# EasyEDA Pro project wukong01-Y003-HTOL - 2.eprj, board PCB1 (continued)
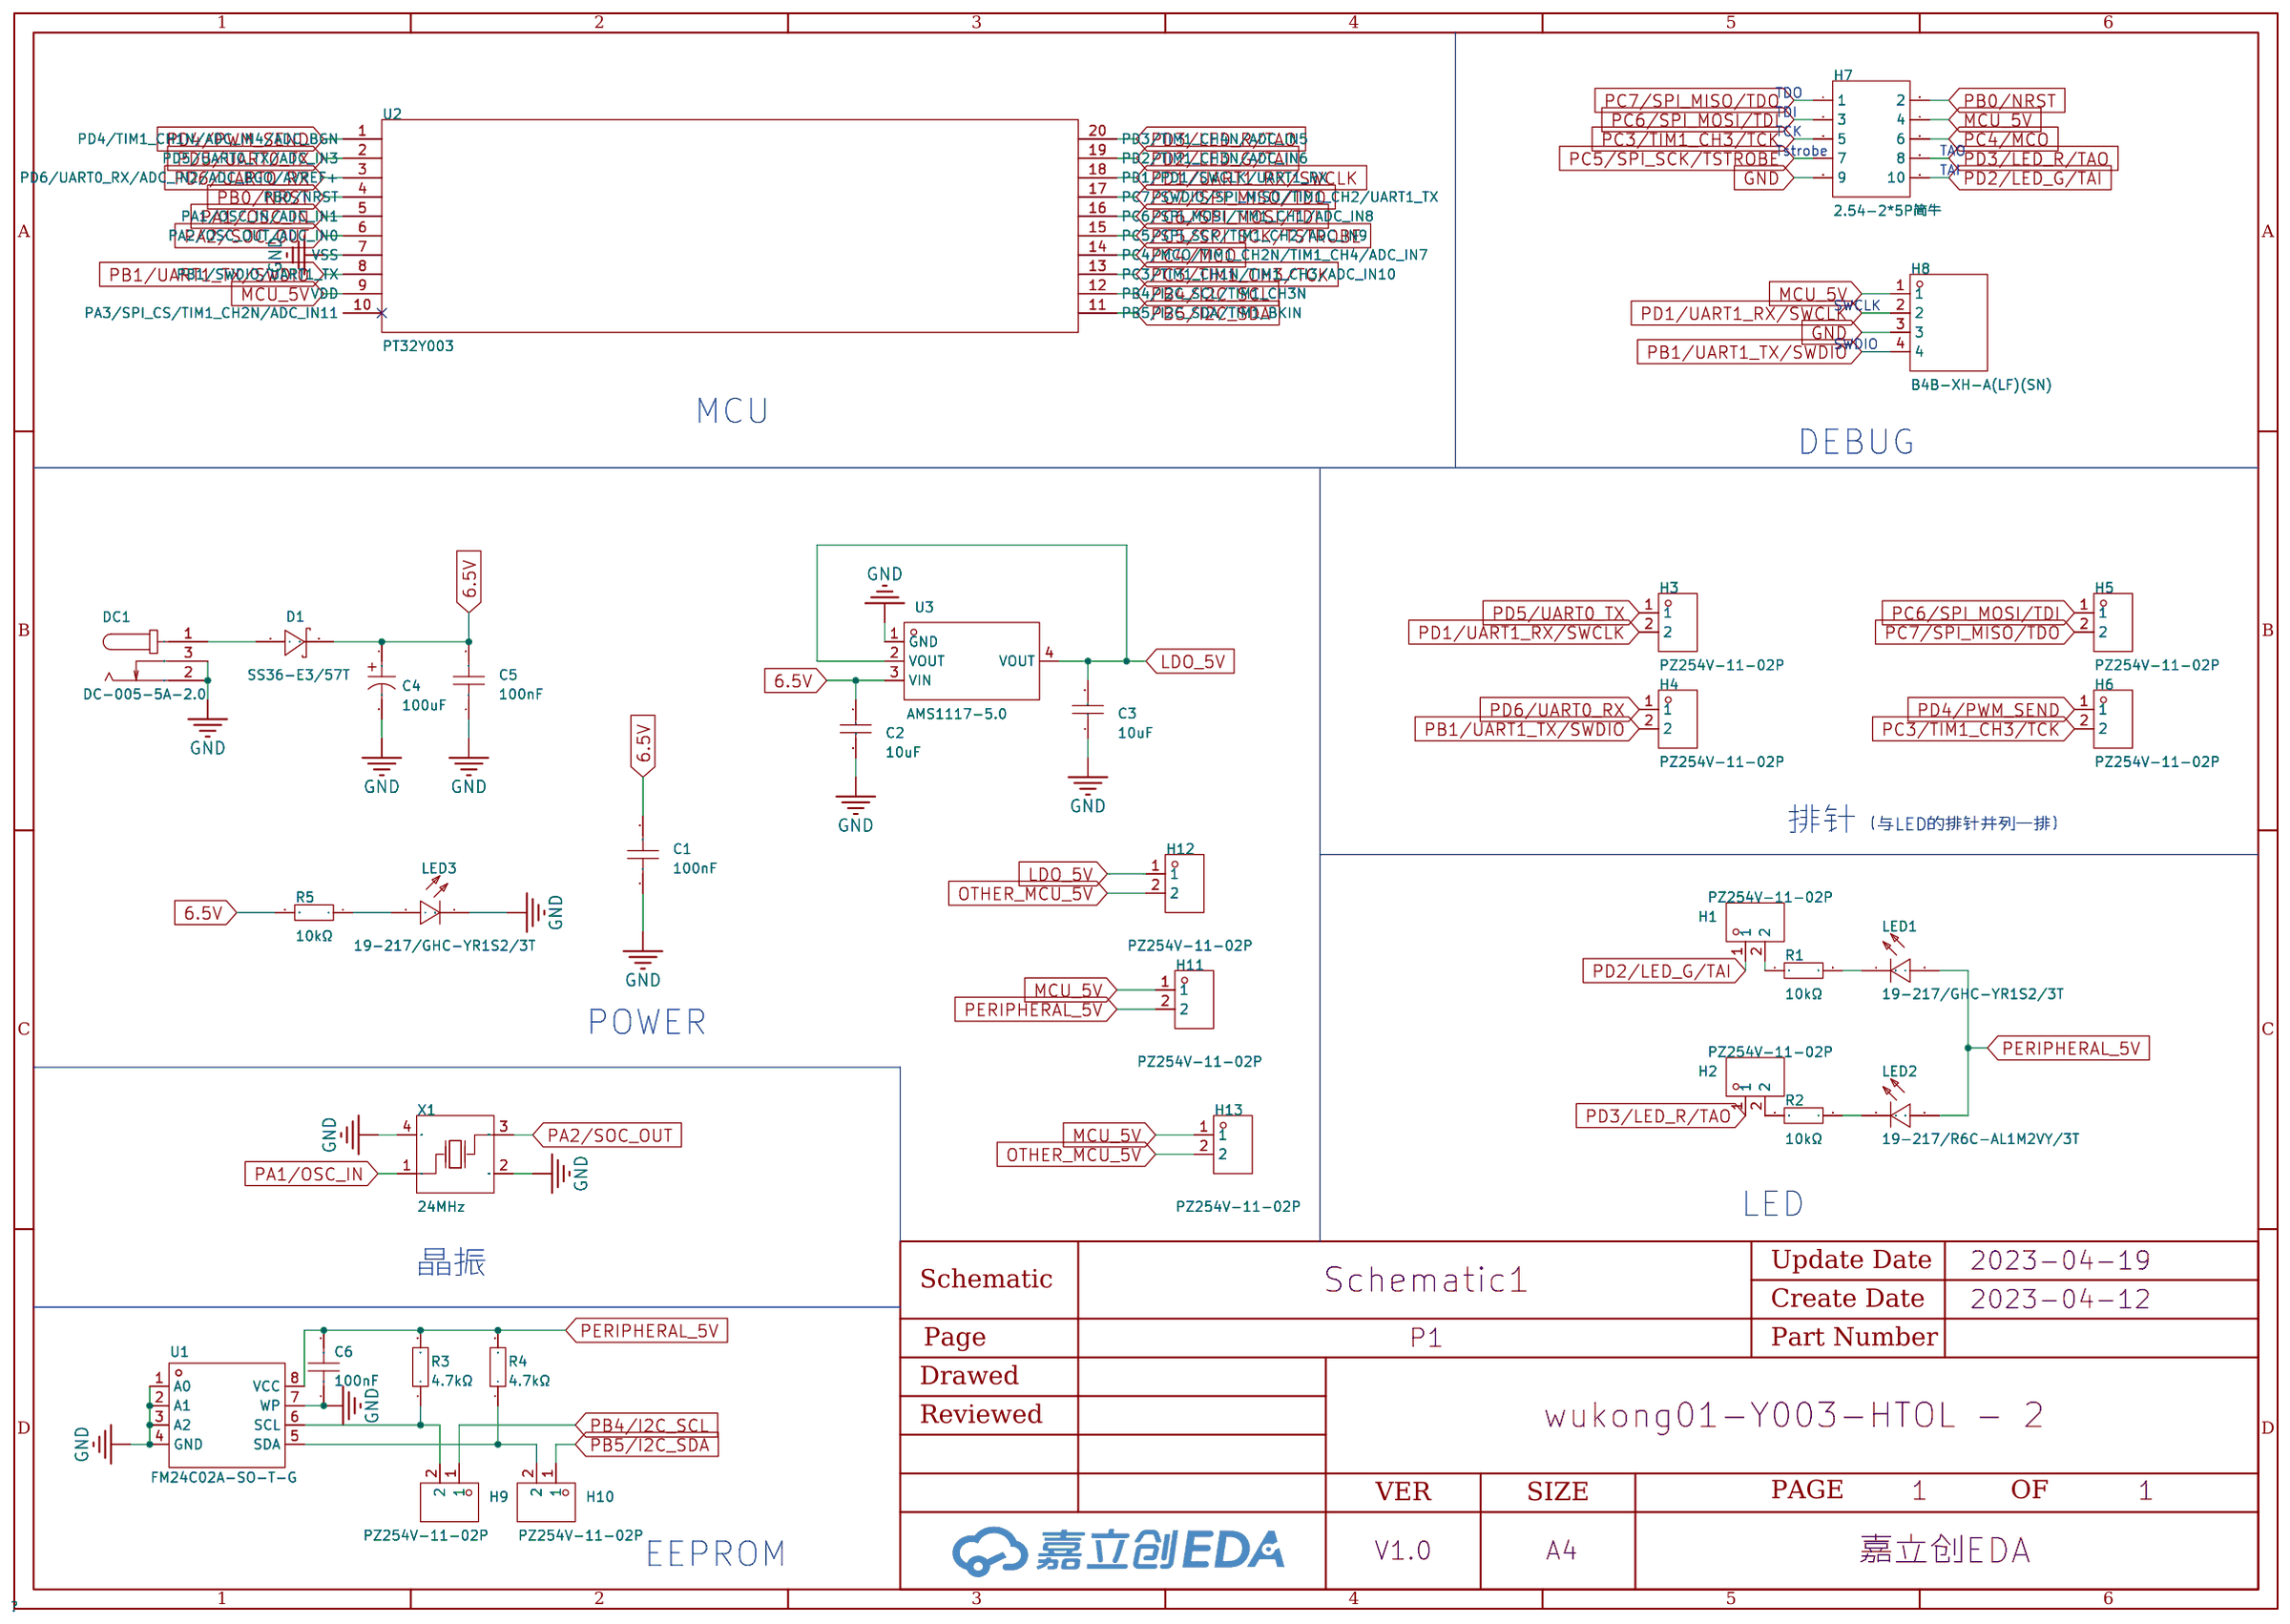
[diagram p0: schematic sheet]
## Placement (name value [footprint] x y rotation side) (continued)
H10#24  -  [HDR-TH_2P-P2.54-V-M]  94.78 55.52 0 top
H10#25  -  [HDR-TH_2P-P2.54-V-M]  139.78 55.52 0 top
H10#26  -  [HDR-TH_2P-P2.54-V-M]  184.78 55.52 0 top
H10#27  -  [HDR-TH_2P-P2.54-V-M]  274.78 55.52 0 top
H10#28  -  [HDR-TH_2P-P2.54-V-M]  49.78 55.52 0 top
H10#29  -  [HDR-TH_2P-P2.54-V-M]  229.78 17.52 0 top
H10#30  -  [HDR-TH_2P-P2.54-V-M]  94.78 17.52 0 top
H10#31  -  [HDR-TH_2P-P2.54-V-M]  139.78 17.52 0 top
H10#32  -  [HDR-TH_2P-P2.54-V-M]  184.78 17.52 0 top
H11  PZ254V-11-02P  [HDR-TH_2P-P2.54-V-M]  94.78 204.98 0 top
H11#2  -  [HDR-TH_2P-P2.54-V-M]  139.78 204.98 0 top
H11#3  -  [HDR-TH_2P-P2.54-V-M]  184.78 204.98 0 top
H11#4  -  [HDR-TH_2P-P2.54-V-M]  229.78 204.98 0 top
H11#5  -  [HDR-TH_2P-P2.54-V-M]  229.78 166.98 0 top
H11#6  -  [HDR-TH_2P-P2.54-V-M]  139.78 166.98 0 top
H11#7  -  [HDR-TH_2P-P2.54-V-M]  94.78 166.98 0 top
H11#8  -  [HDR-TH_2P-P2.54-V-M]  184.78 166.98 0 top
H11#9  -  [HDR-TH_2P-P2.54-V-M]  274.78 166.98 0 top
H11#10  -  [HDR-TH_2P-P2.54-V-M]  49.78 166.98 0 top
H11#11  -  [HDR-TH_2P-P2.54-V-M]  229.78 128.98 0 top
H11#12  -  [HDR-TH_2P-P2.54-V-M]  139.78 128.98 0 top
H11#13  -  [HDR-TH_2P-P2.54-V-M]  94.78 128.98 0 top
H11#14  -  [HDR-TH_2P-P2.54-V-M]  184.78 128.98 0 top
H11#15  -  [HDR-TH_2P-P2.54-V-M]  274.78 128.98 0 top
H11#16  -  [HDR-TH_2P-P2.54-V-M]  49.78 128.98 0 top
H11#17  -  [HDR-TH_2P-P2.54-V-M]  229.78 90.98 0 top
H11#18  -  [HDR-TH_2P-P2.54-V-M]  139.78 90.98 0 top
H11#19  -  [HDR-TH_2P-P2.54-V-M]  94.78 90.98 0 top
H11#20  -  [HDR-TH_2P-P2.54-V-M]  184.78 90.98 0 top
H11#21  -  [HDR-TH_2P-P2.54-V-M]  274.78 90.98 0 top
H11#22  -  [HDR-TH_2P-P2.54-V-M]  49.78 90.98 0 top
H11#23  -  [HDR-TH_2P-P2.54-V-M]  229.78 52.98 0 top
H11#24  -  [HDR-TH_2P-P2.54-V-M]  139.78 52.98 0 top
H11#25  -  [HDR-TH_2P-P2.54-V-M]  94.78 52.98 0 top
H11#26  -  [HDR-TH_2P-P2.54-V-M]  184.78 52.98 0 top
H11#27  -  [HDR-TH_2P-P2.54-V-M]  274.78 52.98 0 top
H11#28  -  [HDR-TH_2P-P2.54-V-M]  49.78 52.98 0 top
H11#29  -  [HDR-TH_2P-P2.54-V-M]  229.78 14.98 0 top
H11#30  -  [HDR-TH_2P-P2.54-V-M]  139.78 14.98 0 top
H11#31  -  [HDR-TH_2P-P2.54-V-M]  94.78 14.98 0 top
H11#32  -  [HDR-TH_2P-P2.54-V-M]  184.78 14.98 0 top
H12  PZ254V-11-02P  [HDR-TH_2P-P2.54-V-M]  5.46 201.29 270 top
H12#2  -  [HDR-TH_2P-P2.54-V-M]  22.71 201.55 270 top
H12#3  -  [HDR-TH_2P-P2.54-V-M]  40.77 201.68 270 top
H12#4  -  [HDR-TH_2P-P2.54-V-M]  55.88 223.27 0 top
H13  PZ254V-11-02P  [HDR-TH_2P-P2.54-V-M]  94.78 202.44 0 top
H13#2  -  [HDR-TH_2P-P2.54-V-M]  139.78 202.44 0 top
H13#3  -  [HDR-TH_2P-P2.54-V-M]  184.78 202.44 0 top
H13#4  -  [HDR-TH_2P-P2.54-V-M]  229.78 202.44 0 top
H13#5  -  [HDR-TH_2P-P2.54-V-M]  139.78 164.44 0 top
H13#6  -  [HDR-TH_2P-P2.54-V-M]  274.78 164.44 0 top
H13#7  -  [HDR-TH_2P-P2.54-V-M]  229.78 164.44 0 top
H13#8  -  [HDR-TH_2P-P2.54-V-M]  94.78 164.44 0 top
H13#9  -  [HDR-TH_2P-P2.54-V-M]  184.78 164.44 0 top
H13#10  -  [HDR-TH_2P-P2.54-V-M]  49.78 164.44 0 top
H13#11  -  [HDR-TH_2P-P2.54-V-M]  139.78 126.44 0 top
H13#12  -  [HDR-TH_2P-P2.54-V-M]  274.78 126.44 0 top
H13#13  -  [HDR-TH_2P-P2.54-V-M]  229.78 126.44 0 top
H13#14  -  [HDR-TH_2P-P2.54-V-M]  94.78 126.44 0 top
H13#15  -  [HDR-TH_2P-P2.54-V-M]  184.78 126.44 0 top
H13#16  -  [HDR-TH_2P-P2.54-V-M]  49.78 126.44 0 top
H13#17  -  [HDR-TH_2P-P2.54-V-M]  139.78 88.44 0 top
H13#18  -  [HDR-TH_2P-P2.54-V-M]  274.78 88.44 0 top
H13#19  -  [HDR-TH_2P-P2.54-V-M]  229.78 88.44 0 top
H13#20  -  [HDR-TH_2P-P2.54-V-M]  94.78 88.44 0 top
H13#21  -  [HDR-TH_2P-P2.54-V-M]  184.78 88.44 0 top
H13#22  -  [HDR-TH_2P-P2.54-V-M]  49.78 88.44 0 top
H13#23  -  [HDR-TH_2P-P2.54-V-M]  139.78 50.44 0 top
H13#24  -  [HDR-TH_2P-P2.54-V-M]  274.78 50.44 0 top
H13#25  -  [HDR-TH_2P-P2.54-V-M]  229.78 50.44 0 top
H13#26  -  [HDR-TH_2P-P2.54-V-M]  94.78 50.44 0 top
H13#27  -  [HDR-TH_2P-P2.54-V-M]  184.78 50.44 0 top
H13#28  -  [HDR-TH_2P-P2.54-V-M]  49.78 50.44 0 top
H13#29  -  [HDR-TH_2P-P2.54-V-M]  139.78 12.44 0 top
H13#30  -  [HDR-TH_2P-P2.54-V-M]  229.78 12.44 0 top
H13#31  -  [HDR-TH_2P-P2.54-V-M]  94.78 12.44 0 top
H13#32  -  [HDR-TH_2P-P2.54-V-M]  184.78 12.44 0 top
J1  -  [DEMO板安装孔]  6.86 5.84 0 top
J2  -  [DEMO板安装孔]  7.49 234.44 0 top
J5  -  [DEMO板安装孔]  283.72 232.92 0 top
J6  -  [DEMO板安装孔]  283.41 5.45 0 top
LED1  19-217/GHC-YR1S2/3T  [LED0603-RD]  81.32 202.31 180 top
LED1#2  -  [LED0603-RD]  126.32 202.31 180 top
LED1#3  -  [LED0603-RD]  171.32 202.31 180 top
LED1#4  -  [LED0603-RD]  216.32 202.31 180 top
LED1#5  -  [LED0603-RD]  171.32 164.31 180 top
LED1#6  -  [LED0603-RD]  81.32 164.31 180 top
LED1#7  -  [LED0603-RD]  216.32 164.31 180 top
LED1#8  -  [LED0603-RD]  126.32 164.31 180 top
LED1#9  -  [LED0603-RD]  261.32 164.31 180 top
LED1#10  -  [LED0603-RD]  36.32 164.31 180 top
LED1#11  -  [LED0603-RD]  171.32 126.31 180 top
LED1#12  -  [LED0603-RD]  81.32 126.31 180 top
LED1#13  -  [LED0603-RD]  216.32 126.31 180 top
LED1#14  -  [LED0603-RD]  126.32 126.31 180 top
LED1#15  -  [LED0603-RD]  261.32 126.31 180 top
LED1#16  -  [LED0603-RD]  36.32 126.31 180 top
LED1#17  -  [LED0603-RD]  171.32 88.31 180 top
LED1#18  -  [LED0603-RD]  81.32 88.31 180 top
LED1#19  -  [LED0603-RD]  216.32 88.31 180 top
LED1#20  -  [LED0603-RD]  126.32 88.31 180 top
LED1#21  -  [LED0603-RD]  261.32 88.31 180 top
LED1#22  -  [LED0603-RD]  36.32 88.31 180 top
LED1#23  -  [LED0603-RD]  171.32 50.31 180 top
LED1#24  -  [LED0603-RD]  81.32 50.31 180 top
LED1#25  -  [LED0603-RD]  216.32 50.31 180 top
LED1#26  -  [LED0603-RD]  126.32 50.31 180 top
LED1#27  -  [LED0603-RD]  261.32 50.31 180 top
LED1#28  -  [LED0603-RD]  36.32 50.31 180 top
LED1#29  -  [LED0603-RD]  171.32 12.31 180 top
LED1#30  -  [LED0603-RD]  81.32 12.31 180 top
LED1#31  -  [LED0603-RD]  216.32 12.31 180 top
LED1#32  -  [LED0603-RD]  126.32 12.31 180 top
LED2  19-217/R6C-AL1M2VY/3T  [LED0603-R-RD]  81.32 203.83 180 top
LED2#2  -  [LED0603-R-RD]  126.32 203.83 180 top
LED2#3  -  [LED0603-R-RD]  171.32 203.83 180 top
LED2#4  -  [LED0603-R-RD]  216.32 203.83 180 top
LED2#5  -  [LED0603-R-RD]  171.32 165.83 180 top
LED2#6  -  [LED0603-R-RD]  81.32 165.83 180 top
LED2#7  -  [LED0603-R-RD]  126.32 165.83 180 top
LED2#8  -  [LED0603-R-RD]  216.32 165.83 180 top
LED2#9  -  [LED0603-R-RD]  261.32 165.83 180 top
LED2#10  -  [LED0603-R-RD]  36.32 165.83 180 top
LED2#11  -  [LED0603-R-RD]  171.32 127.83 180 top
LED2#12  -  [LED0603-R-RD]  81.32 127.83 180 top
LED2#13  -  [LED0603-R-RD]  126.32 127.83 180 top
LED2#14  -  [LED0603-R-RD]  216.32 127.83 180 top
LED2#15  -  [LED0603-R-RD]  261.32 127.83 180 top
LED2#16  -  [LED0603-R-RD]  36.32 127.83 180 top
LED2#17  -  [LED0603-R-RD]  171.32 89.83 180 top
LED2#18  -  [LED0603-R-RD]  81.32 89.83 180 top
LED2#19  -  [LED0603-R-RD]  126.32 89.83 180 top
LED2#20  -  [LED0603-R-RD]  216.32 89.83 180 top
LED2#21  -  [LED0603-R-RD]  261.32 89.83 180 top
LED2#22  -  [LED0603-R-RD]  36.32 89.83 180 top
LED2#23  -  [LED0603-R-RD]  171.32 51.83 180 top
LED2#24  -  [LED0603-R-RD]  81.32 51.83 180 top
LED2#25  -  [LED0603-R-RD]  126.32 51.83 180 top
LED2#26  -  [LED0603-R-RD]  216.32 51.83 180 top
LED2#27  -  [LED0603-R-RD]  261.32 51.83 180 top
LED2#28  -  [LED0603-R-RD]  36.32 51.83 180 top
LED2#29  -  [LED0603-R-RD]  171.32 13.83 180 top
LED2#30  -  [LED0603-R-RD]  81.32 13.83 180 top
LED2#31  -  [LED0603-R-RD]  126.32 13.83 180 top
LED2#32  -  [LED0603-R-RD]  216.32 13.83 180 top
LED3  19-217/GHC-YR1S2/3T  [LED0603-RD]  35.56 219.84 90 top
R1  10kΩ  [R0603]  86.4 202.31 180 top
R1#2  -  [R0603]  221.4 202.31 180 top
R1#3  -  [R0603]  131.4 202.31 180 top
R1#4  -  [R0603]  176.4 202.31 180 top
R1#5  -  [R0603]  176.4 164.31 180 top
R1#6  -  [R0603]  86.4 164.31 180 top
R1#7  -  [R0603]  131.4 164.31 180 top
R1#8  -  [R0603]  266.4 164.31 180 top
R1#9  -  [R0603]  221.4 164.31 180 top
R1#10  -  [R0603]  41.4 164.31 180 top
R1#11  -  [R0603]  176.4 126.31 180 top
R1#12  -  [R0603]  86.4 126.31 180 top
R1#13  -  [R0603]  131.4 126.31 180 top
R1#14  -  [R0603]  266.4 126.31 180 top
R1#15  -  [R0603]  221.4 126.31 180 top
R1#16  -  [R0603]  41.4 126.31 180 top
R1#17  -  [R0603]  176.4 88.31 180 top
R1#18  -  [R0603]  86.4 88.31 180 top
R1#19  -  [R0603]  131.4 88.31 180 top
R1#20  -  [R0603]  266.4 88.31 180 top
R1#21  -  [R0603]  221.4 88.31 180 top
R1#22  -  [R0603]  41.4 88.31 180 top
R1#23  -  [R0603]  176.4 50.31 180 top
R1#24  -  [R0603]  86.4 50.31 180 top
R1#25  -  [R0603]  131.4 50.31 180 top
R1#26  -  [R0603]  266.4 50.31 180 top
R1#27  -  [R0603]  221.4 50.31 180 top
R1#28  -  [R0603]  41.4 50.31 180 top
R1#29  -  [R0603]  176.4 12.31 180 top
R1#30  -  [R0603]  86.4 12.31 180 top
R1#31  -  [R0603]  131.4 12.31 180 top
R1#32  -  [R0603]  221.4 12.31 180 top
R2  10kΩ  [R0603]  86.4 203.83 180 top
R2#2  -  [R0603]  131.4 203.83 180 top
R2#3  -  [R0603]  176.4 203.83 180 top
R2#4  -  [R0603]  221.4 203.83 180 top
R2#5  -  [R0603]  266.4 165.83 180 top
R2#6  -  [R0603]  266.4 127.83 180 top
R2#7  -  [R0603]  86.4 165.83 180 top
R2#8  -  [R0603]  131.4 165.83 180 top
R2#9  -  [R0603]  176.4 165.83 180 top
R2#10  -  [R0603]  221.4 165.83 180 top
R2#11  -  [R0603]  41.4 165.83 180 top
R2#12  -  [R0603]  86.4 127.83 180 top
R2#13  -  [R0603]  131.4 127.83 180 top
R2#14  -  [R0603]  176.4 127.83 180 top
R2#15  -  [R0603]  221.4 127.83 180 top
R2#16  -  [R0603]  41.4 127.83 180 top
R2#17  -  [R0603]  266.4 89.83 180 top
R2#18  -  [R0603]  86.4 89.83 180 top
R2#19  -  [R0603]  131.4 89.83 180 top
R2#20  -  [R0603]  176.4 89.83 180 top
R2#21  -  [R0603]  221.4 89.83 180 top
R2#22  -  [R0603]  41.4 89.83 180 top
R2#23  -  [R0603]  266.4 51.83 180 top
R2#24  -  [R0603]  86.4 51.83 180 top
R2#25  -  [R0603]  131.4 51.83 180 top
R2#26  -  [R0603]  176.4 51.83 180 top
R2#27  -  [R0603]  221.4 51.83 180 top
R2#28  -  [R0603]  41.4 51.83 180 top
R2#29  -  [R0603]  86.4 13.83 180 top
R2#30  -  [R0603]  131.4 13.83 180 top
R2#31  -  [R0603]  176.4 13.83 180 top
R2#32  -  [R0603]  221.4 13.83 180 top
R3  4.7kΩ  [R0603]  72.96 203.74 0 top
R3#2  -  [R0603]  117.96 203.74 0 top
R3#3  -  [R0603]  162.96 203.74 0 top
R3#4  -  [R0603]  207.96 203.74 0 top
R3#5  -  [R0603]  162.96 165.74 0 top
R3#6  -  [R0603]  117.96 165.74 0 top
R3#7  -  [R0603]  207.96 165.74 0 top
R3#8  -  [R0603]  72.96 165.74 0 top
R3#9  -  [R0603]  27.96 165.74 0 top
R3#10  -  [R0603]  252.96 165.74 0 top
R3#11  -  [R0603]  162.96 127.74 0 top
R3#12  -  [R0603]  117.96 127.74 0 top
R3#13  -  [R0603]  207.96 127.74 0 top
R3#14  -  [R0603]  72.96 127.74 0 top
R3#15  -  [R0603]  27.96 127.74 0 top
R3#16  -  [R0603]  252.96 127.74 0 top
R3#17  -  [R0603]  162.96 89.74 0 top
R3#18  -  [R0603]  117.96 89.74 0 top
R3#19  -  [R0603]  207.96 89.74 0 top
R3#20  -  [R0603]  72.96 89.74 0 top
R3#21  -  [R0603]  27.96 89.74 0 top
R3#22  -  [R0603]  252.96 89.74 0 top
R3#23  -  [R0603]  162.96 51.74 0 top
R3#24  -  [R0603]  117.96 51.74 0 top
R3#25  -  [R0603]  207.96 51.74 0 top
R3#26  -  [R0603]  72.96 51.74 0 top
R3#27  -  [R0603]  27.96 51.74 0 top
R3#28  -  [R0603]  252.96 51.74 0 top
R3#29  -  [R0603]  162.96 13.74 0 top
R3#30  -  [R0603]  117.96 13.74 0 top
R3#31  -  [R0603]  207.96 13.74 0 top
R3#32  -  [R0603]  72.96 13.74 0 top
R4  4.7kΩ  [R0603]  72.94 202.18 0 top
R4#2  -  [R0603]  117.94 202.18 0 top
R4#3  -  [R0603]  162.94 202.18 0 top
R4#4  -  [R0603]  207.94 202.18 0 top
R4#5  -  [R0603]  162.94 164.18 0 top
R4#6  -  [R0603]  252.94 164.18 0 top
R4#7  -  [R0603]  117.94 164.18 0 top
R4#8  -  [R0603]  207.94 164.18 0 top
R4#9  -  [R0603]  72.94 164.18 0 top
R4#10  -  [R0603]  27.94 164.18 0 top
R4#11  -  [R0603]  162.94 126.18 0 top
R4#12  -  [R0603]  252.94 126.18 0 top
R4#13  -  [R0603]  117.94 126.18 0 top
R4#14  -  [R0603]  207.94 126.18 0 top
R4#15  -  [R0603]  72.94 126.18 0 top
R4#16  -  [R0603]  27.94 126.18 0 top
R4#17  -  [R0603]  162.94 88.18 0 top
R4#18  -  [R0603]  252.94 88.18 0 top
R4#19  -  [R0603]  117.94 88.18 0 top
R4#20  -  [R0603]  207.94 88.18 0 top
R4#21  -  [R0603]  72.94 88.18 0 top
R4#22  -  [R0603]  27.94 88.18 0 top
R4#23  -  [R0603]  162.94 50.18 0 top
R4#24  -  [R0603]  252.94 50.18 0 top
R4#25  -  [R0603]  117.94 50.18 0 top
R4#26  -  [R0603]  207.94 50.18 0 top
R4#27  -  [R0603]  72.94 50.18 0 top
R4#28  -  [R0603]  27.94 50.18 0 top
R4#29  -  [R0603]  162.94 12.18 0 top
R4#30  -  [R0603]  117.94 12.18 0 top
R4#31  -  [R0603]  207.94 12.18 0 top
R4#32  -  [R0603]  72.94 12.18 0 top
R5  10kΩ  [R0603]  35.56 223.77 90 top
U1  FM24C02A-SO-T-G  [SOP-8_L5.0-W4.0-P1.27-LS6.2-BL]  64.3 204.34 270 top
U1#2  -  [SOP-8_L5.0-W4.0-P1.27-LS6.2-BL]  109.3 204.34 270 top
U1#3  -  [SOP-8_L5.0-W4.0-P1.27-LS6.2-BL]  154.3 204.34 270 top
U1#4  -  [SOP-8_L5.0-W4.0-P1.27-LS6.2-BL]  199.3 204.34 270 top
U1#5  -  [SOP-8_L5.0-W4.0-P1.27-LS6.2-BL]  244.3 166.34 270 top
U1#6  -  [SOP-8_L5.0-W4.0-P1.27-LS6.2-BL]  64.3 166.34 270 top
U1#7  -  [SOP-8_L5.0-W4.0-P1.27-LS6.2-BL]  109.3 166.34 270 top
U1#8  -  [SOP-8_L5.0-W4.0-P1.27-LS6.2-BL]  154.3 166.34 270 top
U1#9  -  [SOP-8_L5.0-W4.0-P1.27-LS6.2-BL]  199.3 166.34 270 top
U1#10  -  [SOP-8_L5.0-W4.0-P1.27-LS6.2-BL]  19.3 166.34 270 top
U1#11  -  [SOP-8_L5.0-W4.0-P1.27-LS6.2-BL]  244.3 128.34 270 top
U1#12  -  [SOP-8_L5.0-W4.0-P1.27-LS6.2-BL]  64.3 128.34 270 top
U1#13  -  [SOP-8_L5.0-W4.0-P1.27-LS6.2-BL]  109.3 128.34 270 top
U1#14  -  [SOP-8_L5.0-W4.0-P1.27-LS6.2-BL]  154.3 128.34 270 top
U1#15  -  [SOP-8_L5.0-W4.0-P1.27-LS6.2-BL]  199.3 128.34 270 top
U1#16  -  [SOP-8_L5.0-W4.0-P1.27-LS6.2-BL]  19.3 128.34 270 top
U1#17  -  [SOP-8_L5.0-W4.0-P1.27-LS6.2-BL]  244.3 90.34 270 top
U1#18  -  [SOP-8_L5.0-W4.0-P1.27-LS6.2-BL]  64.3 90.34 270 top
U1#19  -  [SOP-8_L5.0-W4.0-P1.27-LS6.2-BL]  109.3 90.34 270 top
U1#20  -  [SOP-8_L5.0-W4.0-P1.27-LS6.2-BL]  154.3 90.34 270 top
U1#21  -  [SOP-8_L5.0-W4.0-P1.27-LS6.2-BL]  199.3 90.34 270 top
U1#22  -  [SOP-8_L5.0-W4.0-P1.27-LS6.2-BL]  19.3 90.34 270 top
U1#23  -  [SOP-8_L5.0-W4.0-P1.27-LS6.2-BL]  244.3 52.34 270 top
U1#24  -  [SOP-8_L5.0-W4.0-P1.27-LS6.2-BL]  64.3 52.34 270 top
U1#25  -  [SOP-8_L5.0-W4.0-P1.27-LS6.2-BL]  109.3 52.34 270 top
U1#26  -  [SOP-8_L5.0-W4.0-P1.27-LS6.2-BL]  154.3 52.34 270 top
U1#27  -  [SOP-8_L5.0-W4.0-P1.27-LS6.2-BL]  199.3 52.34 270 top
U1#28  -  [SOP-8_L5.0-W4.0-P1.27-LS6.2-BL]  19.3 52.34 270 top
U1#29  -  [SOP-8_L5.0-W4.0-P1.27-LS6.2-BL]  64.3 14.34 270 top
U1#30  -  [SOP-8_L5.0-W4.0-P1.27-LS6.2-BL]  109.3 14.34 270 top
U1#31  -  [SOP-8_L5.0-W4.0-P1.27-LS6.2-BL]  154.3 14.34 270 top
U1#32  -  [SOP-8_L5.0-W4.0-P1.27-LS6.2-BL]  199.3 14.34 270 top
U2  PT32Y003  [TSSOP-20_L6.5-W4.4-P0.65-LS6.4-BL]  79.67 211.58 270 top
U2#2  -  [TSSOP-20_L6.5-W4.4-P0.65-LS6.4-BL]  124.67 211.58 270 top
U2#3  -  [TSSOP-20_L6.5-W4.4-P0.65-LS6.4-BL]  169.67 211.58 270 top
U2#4  -  [TSSOP-20_L6.5-W4.4-P0.65-LS6.4-BL]  214.67 211.58 270 top
U2#5  -  [TSSOP-20_L6.5-W4.4-P0.65-LS6.4-BL]  79.67 173.58 270 top
U2#6  -  [TSSOP-20_L6.5-W4.4-P0.65-LS6.4-BL]  124.67 173.58 270 top
U2#7  -  [TSSOP-20_L6.5-W4.4-P0.65-LS6.4-BL]  169.67 173.58 270 top
U2#8  -  [TSSOP-20_L6.5-W4.4-P0.65-LS6.4-BL]  214.67 173.58 270 top
U2#9  -  [TSSOP-20_L6.5-W4.4-P0.65-LS6.4-BL]  259.67 173.58 270 top
U2#10  -  [TSSOP-20_L6.5-W4.4-P0.65-LS6.4-BL]  34.67 173.58 270 top
U2#11  -  [TSSOP-20_L6.5-W4.4-P0.65-LS6.4-BL]  79.67 135.58 270 top
U2#12  -  [TSSOP-20_L6.5-W4.4-P0.65-LS6.4-BL]  124.67 135.58 270 top
U2#13  -  [TSSOP-20_L6.5-W4.4-P0.65-LS6.4-BL]  169.67 135.58 270 top
U2#14  -  [TSSOP-20_L6.5-W4.4-P0.65-LS6.4-BL]  214.67 135.58 270 top
U2#15  -  [TSSOP-20_L6.5-W4.4-P0.65-LS6.4-BL]  259.67 135.58 270 top
U2#16  -  [TSSOP-20_L6.5-W4.4-P0.65-LS6.4-BL]  34.67 135.58 270 top
U2#17  -  [TSSOP-20_L6.5-W4.4-P0.65-LS6.4-BL]  79.67 97.58 270 top
U2#18  -  [TSSOP-20_L6.5-W4.4-P0.65-LS6.4-BL]  124.67 97.58 270 top
U2#19  -  [TSSOP-20_L6.5-W4.4-P0.65-LS6.4-BL]  169.67 97.58 270 top
U2#20  -  [TSSOP-20_L6.5-W4.4-P0.65-LS6.4-BL]  214.67 97.58 270 top
U2#21  -  [TSSOP-20_L6.5-W4.4-P0.65-LS6.4-BL]  259.67 97.58 270 top
U2#22  -  [TSSOP-20_L6.5-W4.4-P0.65-LS6.4-BL]  34.67 97.58 270 top
U2#23  -  [TSSOP-20_L6.5-W4.4-P0.65-LS6.4-BL]  79.67 59.58 270 top
U2#24  -  [TSSOP-20_L6.5-W4.4-P0.65-LS6.4-BL]  124.67 59.58 270 top
U2#25  -  [TSSOP-20_L6.5-W4.4-P0.65-LS6.4-BL]  169.67 59.58 270 top
U2#26  -  [TSSOP-20_L6.5-W4.4-P0.65-LS6.4-BL]  214.67 59.58 270 top
U2#27  -  [TSSOP-20_L6.5-W4.4-P0.65-LS6.4-BL]  259.67 59.58 270 top
U2#28  -  [TSSOP-20_L6.5-W4.4-P0.65-LS6.4-BL]  34.67 59.58 270 top
U2#29  -  [TSSOP-20_L6.5-W4.4-P0.65-LS6.4-BL]  79.67 21.58 270 top
U2#30  -  [TSSOP-20_L6.5-W4.4-P0.65-LS6.4-BL]  124.67 21.58 270 top
U2#31  -  [TSSOP-20_L6.5-W4.4-P0.65-LS6.4-BL]  169.67 21.58 270 top
U2#32  -  [TSSOP-20_L6.5-W4.4-P0.65-LS6.4-BL]  214.67 21.58 270 top
U3  AMS1117-5.0  [SOT-223_L6.5-W3.5-P2.30-LS7.0-BR]  15.07 202.82 0 top
U3#2  -  [SOT-223_L6.5-W3.5-P2.30-LS7.0-BR]  32.31 203.07 0 top
U3#3  -  [SOT-223_L6.5-W3.5-P2.30-LS7.0-BR]  50.55 203.2 0 top
U3#4  -  [SOT-223_L6.5-W3.5-P2.30-LS7.0-BR]  47.24 226.82 180 top
X1  24MHz  [CRYSTAL-SMD_4P-L3.2-W2.5-BL]  64.81 211.96 180 top
X1#2  -  [CRYSTAL-SMD_4P-L3.2-W2.5-BL]  109.81 211.96 180 top
X1#3  -  [CRYSTAL-SMD_4P-L3.2-W2.5-BL]  154.81 211.96 180 top
X1#4  -  [CRYSTAL-SMD_4P-L3.2-W2.5-BL]  199.81 211.96 180 top
X1#5  -  [CRYSTAL-SMD_4P-L3.2-W2.5-BL]  109.81 173.96 180 top
X1#6  -  [CRYSTAL-SMD_4P-L3.2-W2.5-BL]  19.81 173.96 180 top
X1#7  -  [CRYSTAL-SMD_4P-L3.2-W2.5-BL]  199.81 173.96 180 top
X1#8  -  [CRYSTAL-SMD_4P-L3.2-W2.5-BL]  154.81 173.96 180 top
X1#9  -  [CRYSTAL-SMD_4P-L3.2-W2.5-BL]  64.81 173.96 180 top
X1#10  -  [CRYSTAL-SMD_4P-L3.2-W2.5-BL]  244.81 173.96 180 top
X1#11  -  [CRYSTAL-SMD_4P-L3.2-W2.5-BL]  109.81 135.96 180 top
X1#12  -  [CRYSTAL-SMD_4P-L3.2-W2.5-BL]  19.81 135.96 180 top
X1#13  -  [CRYSTAL-SMD_4P-L3.2-W2.5-BL]  199.81 135.96 180 top
X1#14  -  [CRYSTAL-SMD_4P-L3.2-W2.5-BL]  154.81 135.96 180 top
X1#15  -  [CRYSTAL-SMD_4P-L3.2-W2.5-BL]  64.81 135.96 180 top
X1#16  -  [CRYSTAL-SMD_4P-L3.2-W2.5-BL]  244.81 135.96 180 top
X1#17  -  [CRYSTAL-SMD_4P-L3.2-W2.5-BL]  109.81 97.96 180 top
X1#18  -  [CRYSTAL-SMD_4P-L3.2-W2.5-BL]  19.81 97.96 180 top
X1#19  -  [CRYSTAL-SMD_4P-L3.2-W2.5-BL]  199.81 97.96 180 top
X1#20  -  [CRYSTAL-SMD_4P-L3.2-W2.5-BL]  154.81 97.96 180 top
X1#21  -  [CRYSTAL-SMD_4P-L3.2-W2.5-BL]  64.81 97.96 180 top
X1#22  -  [CRYSTAL-SMD_4P-L3.2-W2.5-BL]  244.81 97.96 180 top
X1#23  -  [CRYSTAL-SMD_4P-L3.2-W2.5-BL]  109.81 59.96 180 top
X1#24  -  [CRYSTAL-SMD_4P-L3.2-W2.5-BL]  19.81 59.96 180 top
X1#25  -  [CRYSTAL-SMD_4P-L3.2-W2.5-BL]  199.81 59.96 180 top
X1#26  -  [CRYSTAL-SMD_4P-L3.2-W2.5-BL]  154.81 59.96 180 top
X1#27  -  [CRYSTAL-SMD_4P-L3.2-W2.5-BL]  64.81 59.96 180 top
X1#28  -  [CRYSTAL-SMD_4P-L3.2-W2.5-BL]  244.81 59.96 180 top
X1#29  -  [CRYSTAL-SMD_4P-L3.2-W2.5-BL]  109.81 21.96 180 top
X1#30  -  [CRYSTAL-SMD_4P-L3.2-W2.5-BL]  199.81 21.96 180 top
X1#31  -  [CRYSTAL-SMD_4P-L3.2-W2.5-BL]  154.81 21.96 180 top
X1#32  -  [CRYSTAL-SMD_4P-L3.2-W2.5-BL]  64.81 21.96 180 top

## Footprints (pads in the part's own frame, mm; a bottom-side part is the same pattern mirrored in y, then rotated)
C0603
  rect 0.8x0.9 smd: 1(-0.7,0) 2(0.7,0)
C1206
  rect 1.485x1.728 smd: 1(-1.593,0) 2(1.593,0)
CAP-SMD_BD6.3-L6.6-W6.6-LS7.6-FD-1
  rect 3.5x1.2 smd: 1(-2.67,0) 2(2.67,0)
CONN-TH_B4B-XH-A-LF-SN
  round 1.7 hole 1: 1(-3.81,0) 2(-1.27,0) 3(1.27,0) 4(3.81,0)
CRYSTAL-SMD_4P-L3.2-W2.5-BL
  rect 1.4x1.2 smd: 1(-1.1,-0.85) 2(1.1,-0.85) 3(1.1,0.85) 4(-1.1,0.85)
DC-IN-TH_DC-005-5A-2.0
  oval 1.8x4.2 hole 1x3.5: 1(3,2.352)
  oval 1.8x4 hole 1x3.3: 2(-3,2.352)
  oval 4x1.8 hole 3.3x1: 3(-0.001,-2.352)
DEMO板安装孔
  round 6.32 hole 2.75: 1(0,0)
HDR-TH_2P-P2.54-V-M
  rect 2x2 hole 1.2: 1(-1.27,0)
  round 2 hole 1.2: 2(1.27,0)
IDC-TH_10P-P2.54_C5665
  round 1.524 hole 1: 1(-5.08,-1.27) 2(-5.08,1.27) 3(-2.54,-1.27) 4(-2.54,1.27) 5(0,-1.27) 6(0,1.27) 7(2.54,-1.27) 8(2.54,1.27) 9(5.08,-1.27) 10(5.08,1.27)
LED0603-R-RD
  rect 0.8x0.8 smd: 1(0.851,0) 2(-0.851,0)
LED0603-RD
  rect 0.8x0.8 smd: 1(-0.799,-0.004) 2(0.799,0.004)
R0603
  rect 0.806x0.864 smd: 1(-0.753,0) 2(0.753,0)
SMC_L7.1-W6.2-LS8.1-R-RD
  rect 3.03x3.82 smd: 1(3.435,0) 2(-3.435,0)
SOP-8_L5.0-W4.0-P1.27-LS6.2-BL
  oval 0.7x1.7 smd: 1(-1.905,-2.9) 2(-0.635,-2.9) 3(0.635,-2.9) 4(1.905,-2.9) 5(1.905,2.9) 6(0.635,2.9) 7(-0.635,2.9) 8(-1.905,2.9)
SOT-223_L6.5-W3.5-P2.30-LS7.0-BR
  rect 2.465x1.05 smd: 1(2.857,-2.3) 2(2.857,0) 3(2.857,2.3)
  rect 2.465x3.54 smd: 4(-2.857,0)
TSSOP-20_L6.5-W4.4-P0.65-LS6.4-BL
  oval 0.364x1.742 smd: 1(-2.925,-2.871) 2(-2.275,-2.871) 3(-1.625,-2.871) 4(-0.975,-2.871) 5(-0.325,-2.871) 6(0.325,-2.871) 7(0.975,-2.871) 8(1.625,-2.871) 9(2.275,-2.871) 10(2.925,-2.871) 11(2.925,2.871) 12(2.275,2.871) 13(1.625,2.871) 14(0.975,2.871) 15(0.325,2.871) 16(-0.325,2.871) 17(-0.975,2.871) 18(-1.625,2.871) 19(-2.275,2.871) 20(-2.925,2.871)

## Nets
6.5V: C1.2 C2.1 C4.1 C5.2 D1.2 R5.2 U3.3 U3#2.3 U3#3.3 U3#4.3
GND: C1.1 C2.2 C3.1 C3#2.1 C3#3.1 C3#4.1 C4.2 C5.1 C6.1 C6#2.1 C6#3.1 C6#4.1 C6#5.1 C6#6.1 C6#7.1 C6#8.1 C6#9.1 C6#10.1 C6#11.1 C6#12.1 C6#13.1 C6#14.1 C6#15.1 C6#16.1 C6#17.1 C6#18.1 C6#19.1 C6#20.1 C6#21.1 C6#22.1 C6#23.1 C6#24.1 C6#25.1 C6#26.1 C6#27.1 C6#28.1 C6#29.1 C6#30.1 C6#31.1 C6#32.1 DC1.2 DC1.3 H7.9 H7#2.9 H7#3.9 H7#4.9 H7#5.9 H7#6.9 H7#7.9 H7#8.9 H7#9.9 H7#10.9 H7#11.9 H7#12.9 H7#13.9 H7#14.9 H7#15.9 H7#16.9 H7#17.9 H7#18.9 H7#19.9 H7#20.9 H7#21.9 H7#22.9 H7#23.9 H7#24.9 H7#25.9 H7#26.9 H7#27.9 H7#28.9 H7#29.9 H7#30.9 H7#31.9 H7#32.9 H8.3 H8#2.3 H8#3.3 H8#4.3 H8#5.3 H8#6.3 H8#7.3 H8#8.3 H8#9.3 H8#10.3 H8#11.3 H8#12.3 H8#13.3 H8#14.3 H8#15.3 H8#16.3 H8#17.3 H8#18.3 H8#19.3 H8#20.3 H8#21.3 H8#22.3 H8#23.3 H8#24.3 H8#25.3 H8#26.3 H8#27.3 H8#28.3 H8#29.3 H8#30.3 H8#31.3 H8#32.3 J5.1 J6.1 LED3.1 U1.1 U1.2 U1.3 U1.4 U1.7 U1#2.1 U1#2.2 U1#2.3 U1#2.4 U1#2.7 U1#3.1 U1#3.2 U1#3.3 U1#3.4 U1#3.7 U1#4.1 U1#4.2 U1#4.3 U1#4.4 U1#4.7 U1#5.1 U1#5.2 U1#5.3 U1#5.4 U1#5.7 U1#6.1 U1#6.2 U1#6.3 U1#6.4 U1#6.7 U1#7.1 U1#7.2 U1#7.3 U1#7.4 U1#7.7 U1#8.1 U1#8.2 U1#8.3 U1#8.4 U1#8.7 U1#9.1 U1#9.2 U1#9.3 U1#9.4 U1#9.7 U1#10.1 U1#10.2 U1#10.3 U1#10.4 U1#10.7 U1#11.1 U1#11.2 U1#11.3 U1#11.4 U1#11.7 U1#12.1 U1#12.2 U1#12.3 U1#12.4 U1#12.7 U1#13.1 U1#13.2 U1#13.3 U1#13.4 U1#13.7 U1#14.1 U1#14.2 U1#14.3 U1#14.4 U1#14.7 U1#15.1 U1#15.2 U1#15.3 U1#15.4 U1#15.7 U1#16.1 U1#16.2 U1#16.3 U1#16.4 U1#16.7 U1#17.1 U1#17.2 U1#17.3 U1#17.4 U1#17.7 U1#18.1 U1#18.2 U1#18.3 U1#18.4 U1#18.7 U1#19.1 U1#19.2 U1#19.3 U1#19.4 U1#19.7 U1#20.1 U1#20.2 U1#20.3 U1#20.4 U1#20.7 U1#21.1 U1#21.2 U1#21.3 U1#21.4 U1#21.7 U1#22.1 U1#22.2 U1#22.3 U1#22.4 U1#22.7 U1#23.1 U1#23.2 U1#23.3 U1#23.4 U1#23.7 U1#24.1 U1#24.2 U1#24.3 U1#24.4 U1#24.7 U1#25.1 U1#25.2 U1#25.3 U1#25.4 U1#25.7 U1#26.1 U1#26.2 U1#26.3 U1#26.4 U1#26.7 U1#27.1 U1#27.2 U1#27.3 U1#27.4 U1#27.7 U1#28.1 U1#28.2 U1#28.3 U1#28.4 U1#28.7 U1#29.1 U1#29.2 U1#29.3 U1#29.4 U1#29.7 U1#30.1 U1#30.2 U1#30.3 U1#30.4 U1#30.7 U1#31.1 U1#31.2 U1#31.3 U1#31.4 U1#31.7 U1#32.1 U1#32.2 U1#32.3 U1#32.4 U1#32.7 U2.7 U2#2.7 U2#3.7 U2#4.7 U2#5.7 U2#6.7 U2#7.7 U2#8.7 U2#9.7 U2#10.7 U2#11.7 U2#12.7 U2#13.7 U2#14.7 U2#15.7 U2#16.7 U2#17.7 U2#18.7 U2#19.7 U2#20.7 U2#21.7 U2#22.7 U2#23.7 U2#24.7 U2#25.7 U2#26.7 U2#27.7 U2#28.7 U2#29.7 U2#30.7 U2#31.7 U2#32.7 U3.1 U3#2.1 U3#3.1 U3#4.1 X1.2 X1.4 X1#2.2 X1#2.4 X1#3.2 X1#3.4 X1#4.2 X1#4.4 X1#5.2 X1#5.4 X1#6.2 X1#6.4 X1#7.2 X1#7.4 X1#8.2 X1#8.4 X1#9.2 X1#9.4 X1#10.2 X1#10.4 X1#11.2 X1#11.4 X1#12.2 X1#12.4 X1#13.2 X1#13.4 X1#14.2 X1#14.4 X1#15.2 X1#15.4 X1#16.2 X1#16.4 X1#17.2 X1#17.4 X1#18.2 X1#18.4 X1#19.2 X1#19.4 X1#20.2 X1#20.4 X1#21.2 X1#21.4 X1#22.2 X1#22.4 X1#23.2 X1#23.4 X1#24.2 X1#24.4 X1#25.2 X1#25.4 X1#26.2 X1#26.4 X1#27.2 X1#27.4 X1#28.2 X1#28.4 X1#29.2 X1#29.4 X1#30.2 X1#30.4 X1#31.2 X1#31.4 X1#32.2 X1#32.4
LDO_5V: C3.2 C3#2.2 C3#3.2 C3#4.2 H12.1 H12#2.1 H12#3.1 H12#4.1 U3.2 U3.4 U3#2.2 U3#2.4 U3#3.2 U3#3.4 U3#4.2 U3#4.4
MCU_5V: H7.4 H7#2.4 H7#3.4 H7#4.4 H7#5.4 H7#6.4 H7#7.4 H7#8.4 H7#9.4 H7#10.4 H7#11.4 H7#12.4 H7#13.4 H7#14.4 H7#15.4 H7#16.4 H7#17.4 H7#18.4 H7#19.4 H7#20.4 H7#21.4 H7#22.4 H7#23.4 H7#24.4 H7#25.4 H7#26.4 H7#27.4 H7#28.4 H7#29.4 H7#30.4 H7#31.4 H7#32.4 H8.1 H8#2.1 H8#3.1 H8#4.1 H8#5.1 H8#6.1 H8#7.1 H8#8.1 H8#9.1 H8#10.1 H8#11.1 H8#12.1 H8#13.1 H8#14.1 H8#15.1 H8#16.1 H8#17.1 H8#18.1 H8#19.1 H8#20.1 H8#21.1 H8#22.1 H8#23.1 H8#24.1 H8#25.1 H8#26.1 H8#27.1 H8#28.1 H8#29.1 H8#30.1 H8#31.1 H8#32.1 H11.1 H11#2.1 H11#3.1 H11#4.1 H11#5.1 H11#6.1 H11#7.1 H11#8.1 H11#9.1 H11#10.1 H11#11.1 H11#12.1 H11#13.1 H11#14.1 H11#15.1 H11#16.1 H11#17.1 H11#18.1 H11#19.1 H11#20.1 H11#21.1 H11#22.1 H11#23.1 H11#24.1 H11#25.1 H11#26.1 H11#27.1 H11#28.1 H11#29.1 H11#30.1 H11#31.1 H11#32.1 H13.1 H13#2.1 H13#3.1 H13#4.1 H13#5.1 H13#6.1 H13#7.1 H13#8.1 H13#9.1 H13#10.1 H13#11.1 H13#12.1 H13#13.1 H13#14.1 H13#15.1 H13#16.1 H13#17.1 H13#18.1 H13#19.1 H13#20.1 H13#21.1 H13#22.1 H13#23.1 H13#24.1 H13#25.1 H13#26.1 H13#27.1 H13#28.1 H13#29.1 H13#30.1 H13#31.1 H13#32.1 U2.9 U2#2.9 U2#3.9 U2#4.9 U2#5.9 U2#6.9 U2#7.9 U2#8.9 U2#9.9 U2#10.9 U2#11.9 U2#12.9 U2#13.9 U2#14.9 U2#15.9 U2#16.9 U2#17.9 U2#18.9 U2#19.9 U2#20.9 U2#21.9 U2#22.9 U2#23.9 U2#24.9 U2#25.9 U2#26.9 U2#27.9 U2#28.9 U2#29.9 U2#30.9 U2#31.9 U2#32.9
OTHER_MCU_5V: H12.2 H12#2.2 H12#3.2 H12#4.2 H13.2 H13#2.2 H13#3.2 H13#4.2 H13#5.2 H13#6.2 H13#7.2 H13#8.2 H13#9.2 H13#10.2 H13#11.2 H13#12.2 H13#13.2 H13#14.2 H13#15.2 H13#16.2 H13#17.2 H13#18.2 H13#19.2 H13#20.2 H13#21.2 H13#22.2 H13#23.2 H13#24.2 H13#25.2 H13#26.2 H13#27.2 H13#28.2 H13#29.2 H13#30.2 H13#31.2 H13#32.2
PA1/OSC_IN: U2.5 U2#2.5 U2#3.5 U2#4.5 U2#5.5 U2#6.5 U2#7.5 U2#8.5 U2#9.5 U2#10.5 U2#11.5 U2#12.5 U2#13.5 U2#14.5 U2#15.5 U2#16.5 U2#17.5 U2#18.5 U2#19.5 U2#20.5 U2#21.5 U2#22.5 U2#23.5 U2#24.5 U2#25.5 U2#26.5 U2#27.5 U2#28.5 U2#29.5 U2#30.5 U2#31.5 U2#32.5 X1.1 X1#2.1 X1#3.1 X1#4.1 X1#5.1 X1#6.1 X1#7.1 X1#8.1 X1#9.1 X1#10.1 X1#11.1 X1#12.1 X1#13.1 X1#14.1 X1#15.1 X1#16.1 X1#17.1 X1#18.1 X1#19.1 X1#20.1 X1#21.1 X1#22.1 X1#23.1 X1#24.1 X1#25.1 X1#26.1 X1#27.1 X1#28.1 X1#29.1 X1#30.1 X1#31.1 X1#32.1
PA2/SOC_OUT: U2.6 U2#2.6 U2#3.6 U2#4.6 U2#5.6 U2#6.6 U2#7.6 U2#8.6 U2#9.6 U2#10.6 U2#11.6 U2#12.6 U2#13.6 U2#14.6 U2#15.6 U2#16.6 U2#17.6 U2#18.6 U2#19.6 U2#20.6 U2#21.6 U2#22.6 U2#23.6 U2#24.6 U2#25.6 U2#26.6 U2#27.6 U2#28.6 U2#29.6 U2#30.6 U2#31.6 U2#32.6 X1.3 X1#2.3 X1#3.3 X1#4.3 X1#5.3 X1#6.3 X1#7.3 X1#8.3 X1#9.3 X1#10.3 X1#11.3 X1#12.3 X1#13.3 X1#14.3 X1#15.3 X1#16.3 X1#17.3 X1#18.3 X1#19.3 X1#20.3 X1#21.3 X1#22.3 X1#23.3 X1#24.3 X1#25.3 X1#26.3 X1#27.3 X1#28.3 X1#29.3 X1#30.3 X1#31.3 X1#32.3
PB0/NRST: H7.2 H7#2.2 H7#3.2 H7#4.2 H7#5.2 H7#6.2 H7#7.2 H7#8.2 H7#9.2 H7#10.2 H7#11.2 H7#12.2 H7#13.2 H7#14.2 H7#15.2 H7#16.2 H7#17.2 H7#18.2 H7#19.2 H7#20.2 H7#21.2 H7#22.2 H7#23.2 H7#24.2 H7#25.2 H7#26.2 H7#27.2 H7#28.2 H7#29.2 H7#30.2 H7#31.2 H7#32.2 U2.4 U2#2.4 U2#3.4 U2#4.4 U2#5.4 U2#6.4 U2#7.4 U2#8.4 U2#9.4 U2#10.4 U2#11.4 U2#12.4 U2#13.4 U2#14.4 U2#15.4 U2#16.4 U2#17.4 U2#18.4 U2#19.4 U2#20.4 U2#21.4 U2#22.4 U2#23.4 U2#24.4 U2#25.4 U2#26.4 U2#27.4 U2#28.4 U2#29.4 U2#30.4 U2#31.4 U2#32.4
PB1/UART1_TX/SWDIO: H4.2 H4#2.2 H4#3.2 H4#4.2 H4#5.2 H4#6.2 H4#7.2 H4#8.2 H4#9.2 H4#10.2 H4#11.2 H4#12.2 H4#13.2 H4#14.2 H4#15.2 H4#16.2 H4#17.2 H4#18.2 H4#19.2 H4#20.2 H4#21.2 H4#22.2 H4#23.2 H4#24.2 H4#25.2 H4#26.2 H4#27.2 H4#28.2 H4#29.2 H4#30.2 H4#31.2 H4#32.2 H8.4 H8#2.4 H8#3.4 H8#4.4 H8#5.4 H8#6.4 H8#7.4 H8#8.4 H8#9.4 H8#10.4 H8#11.4 H8#12.4 H8#13.4 H8#14.4 H8#15.4 H8#16.4 H8#17.4 H8#18.4 H8#19.4 H8#20.4 H8#21.4 H8#22.4 H8#23.4 H8#24.4 H8#25.4 H8#26.4 H8#27.4 H8#28.4 H8#29.4 H8#30.4 H8#31.4 H8#32.4 U2.8 U2#2.8 U2#3.8 U2#4.8 U2#5.8 U2#6.8 U2#7.8 U2#8.8 U2#9.8 U2#10.8 U2#11.8 U2#12.8 U2#13.8 U2#14.8 U2#15.8 U2#16.8 U2#17.8 U2#18.8 U2#19.8 U2#20.8 U2#21.8 U2#22.8 U2#23.8 U2#24.8 U2#25.8 U2#26.8 U2#27.8 U2#28.8 U2#29.8 U2#30.8 U2#31.8 U2#32.8
PB4/I2C_SCL: H9.1 H9#2.1 H9#3.1 H9#4.1 H9#5.1 H9#6.1 H9#7.1 H9#8.1 H9#9.1 H9#10.1 H9#11.1 H9#12.1 H9#13.1 H9#14.1 H9#15.1 H9#16.1 H9#17.1 H9#18.1 H9#19.1 H9#20.1 H9#21.1 H9#22.1 H9#23.1 H9#24.1 H9#25.1 H9#26.1 H9#27.1 H9#28.1 H9#29.1 H9#30.1 H9#31.1 H9#32.1 U2.12 U2#2.12 U2#3.12 U2#4.12 U2#5.12 U2#6.12 U2#7.12 U2#8.12 U2#9.12 U2#10.12 U2#11.12 U2#12.12 U2#13.12 U2#14.12 U2#15.12 U2#16.12 U2#17.12 U2#18.12 U2#19.12 U2#20.12 U2#21.12 U2#22.12 U2#23.12 U2#24.12 U2#25.12 U2#26.12 U2#27.12 U2#28.12 U2#29.12 U2#30.12 U2#31.12 U2#32.12
PB5/I2C_SDA: H10.1 H10#2.1 H10#3.1 H10#4.1 H10#5.1 H10#6.1 H10#7.1 H10#8.1 H10#9.1 H10#10.1 H10#11.1 H10#12.1 H10#13.1 H10#14.1 H10#15.1 H10#16.1 H10#17.1 H10#18.1 H10#19.1 H10#20.1 H10#21.1 H10#22.1 H10#23.1 H10#24.1 H10#25.1 H10#26.1 H10#27.1 H10#28.1 H10#29.1 H10#30.1 H10#31.1 H10#32.1 U2.11 U2#2.11 U2#3.11 U2#4.11 U2#5.11 U2#6.11 U2#7.11 U2#8.11 U2#9.11 U2#10.11 U2#11.11 U2#12.11 U2#13.11 U2#14.11 U2#15.11 U2#16.11 U2#17.11 U2#18.11 U2#19.11 U2#20.11 U2#21.11 U2#22.11 U2#23.11 U2#24.11 U2#25.11 U2#26.11 U2#27.11 U2#28.11 U2#29.11 U2#30.11 U2#31.11 U2#32.11
PC3/TIM1_CH3/TCK: H6.2 H6#2.2 H6#3.2 H6#4.2 H6#5.2 H6#6.2 H6#7.2 H6#8.2 H6#9.2 H6#10.2 H6#11.2 H6#12.2 H6#13.2 H6#14.2 H6#15.2 H6#16.2 H6#17.2 H6#18.2 H6#19.2 H6#20.2 H6#21.2 H6#22.2 H6#23.2 H6#24.2 H6#25.2 H6#26.2 H6#27.2 H6#28.2 H6#29.2 H6#30.2 H6#31.2 H6#32.2 H7.5 H7#2.5 H7#3.5 H7#4.5 H7#5.5 H7#6.5 H7#7.5 H7#8.5 H7#9.5 H7#10.5 H7#11.5 H7#12.5 H7#13.5 H7#14.5 H7#15.5 H7#16.5 H7#17.5 H7#18.5 H7#19.5 H7#20.5 H7#21.5 H7#22.5 H7#23.5 H7#24.5 H7#25.5 H7#26.5 H7#27.5 H7#28.5 H7#29.5 H7#30.5 H7#31.5 H7#32.5 U2.13 U2#2.13 U2#3.13 U2#4.13 U2#5.13 U2#6.13 U2#7.13 U2#8.13 U2#9.13 U2#10.13 U2#11.13 U2#12.13 U2#13.13 U2#14.13 U2#15.13 U2#16.13 U2#17.13 U2#18.13 U2#19.13 U2#20.13 U2#21.13 U2#22.13 U2#23.13 U2#24.13 U2#25.13 U2#26.13 U2#27.13 U2#28.13 U2#29.13 U2#30.13 U2#31.13 U2#32.13
PC4/MCO: H7.6 H7#2.6 H7#3.6 H7#4.6 H7#5.6 H7#6.6 H7#7.6 H7#8.6 H7#9.6 H7#10.6 H7#11.6 H7#12.6 H7#13.6 H7#14.6 H7#15.6 H7#16.6 H7#17.6 H7#18.6 H7#19.6 H7#20.6 H7#21.6 H7#22.6 H7#23.6 H7#24.6 H7#25.6 H7#26.6 H7#27.6 H7#28.6 H7#29.6 H7#30.6 H7#31.6 H7#32.6 U2.14 U2#2.14 U2#3.14 U2#4.14 U2#5.14 U2#6.14 U2#7.14 U2#8.14 U2#9.14 U2#10.14 U2#11.14 U2#12.14 U2#13.14 U2#14.14 U2#15.14 U2#16.14 U2#17.14 U2#18.14 U2#19.14 U2#20.14 U2#21.14 U2#22.14 U2#23.14 U2#24.14 U2#25.14 U2#26.14 U2#27.14 U2#28.14 U2#29.14 U2#30.14 U2#31.14 U2#32.14
PC5/SPI_SCK/TSTROBE: H7.7 H7#2.7 H7#3.7 H7#4.7 H7#5.7 H7#6.7 H7#7.7 H7#8.7 H7#9.7 H7#10.7 H7#11.7 H7#12.7 H7#13.7 H7#14.7 H7#15.7 H7#16.7 H7#17.7 H7#18.7 H7#19.7 H7#20.7 H7#21.7 H7#22.7 H7#23.7 H7#24.7 H7#25.7 H7#26.7 H7#27.7 H7#28.7 H7#29.7 H7#30.7 H7#31.7 H7#32.7 U2.15 U2#2.15 U2#3.15 U2#4.15 U2#5.15 U2#6.15 U2#7.15 U2#8.15 U2#9.15 U2#10.15 U2#11.15 U2#12.15 U2#13.15 U2#14.15 U2#15.15 U2#16.15 U2#17.15 U2#18.15 U2#19.15 U2#20.15 U2#21.15 U2#22.15 U2#23.15 U2#24.15 U2#25.15 U2#26.15 U2#27.15 U2#28.15 U2#29.15 U2#30.15 U2#31.15 U2#32.15
